# EasyEDA Pro project PR.eprj, schematic 新大符2.0
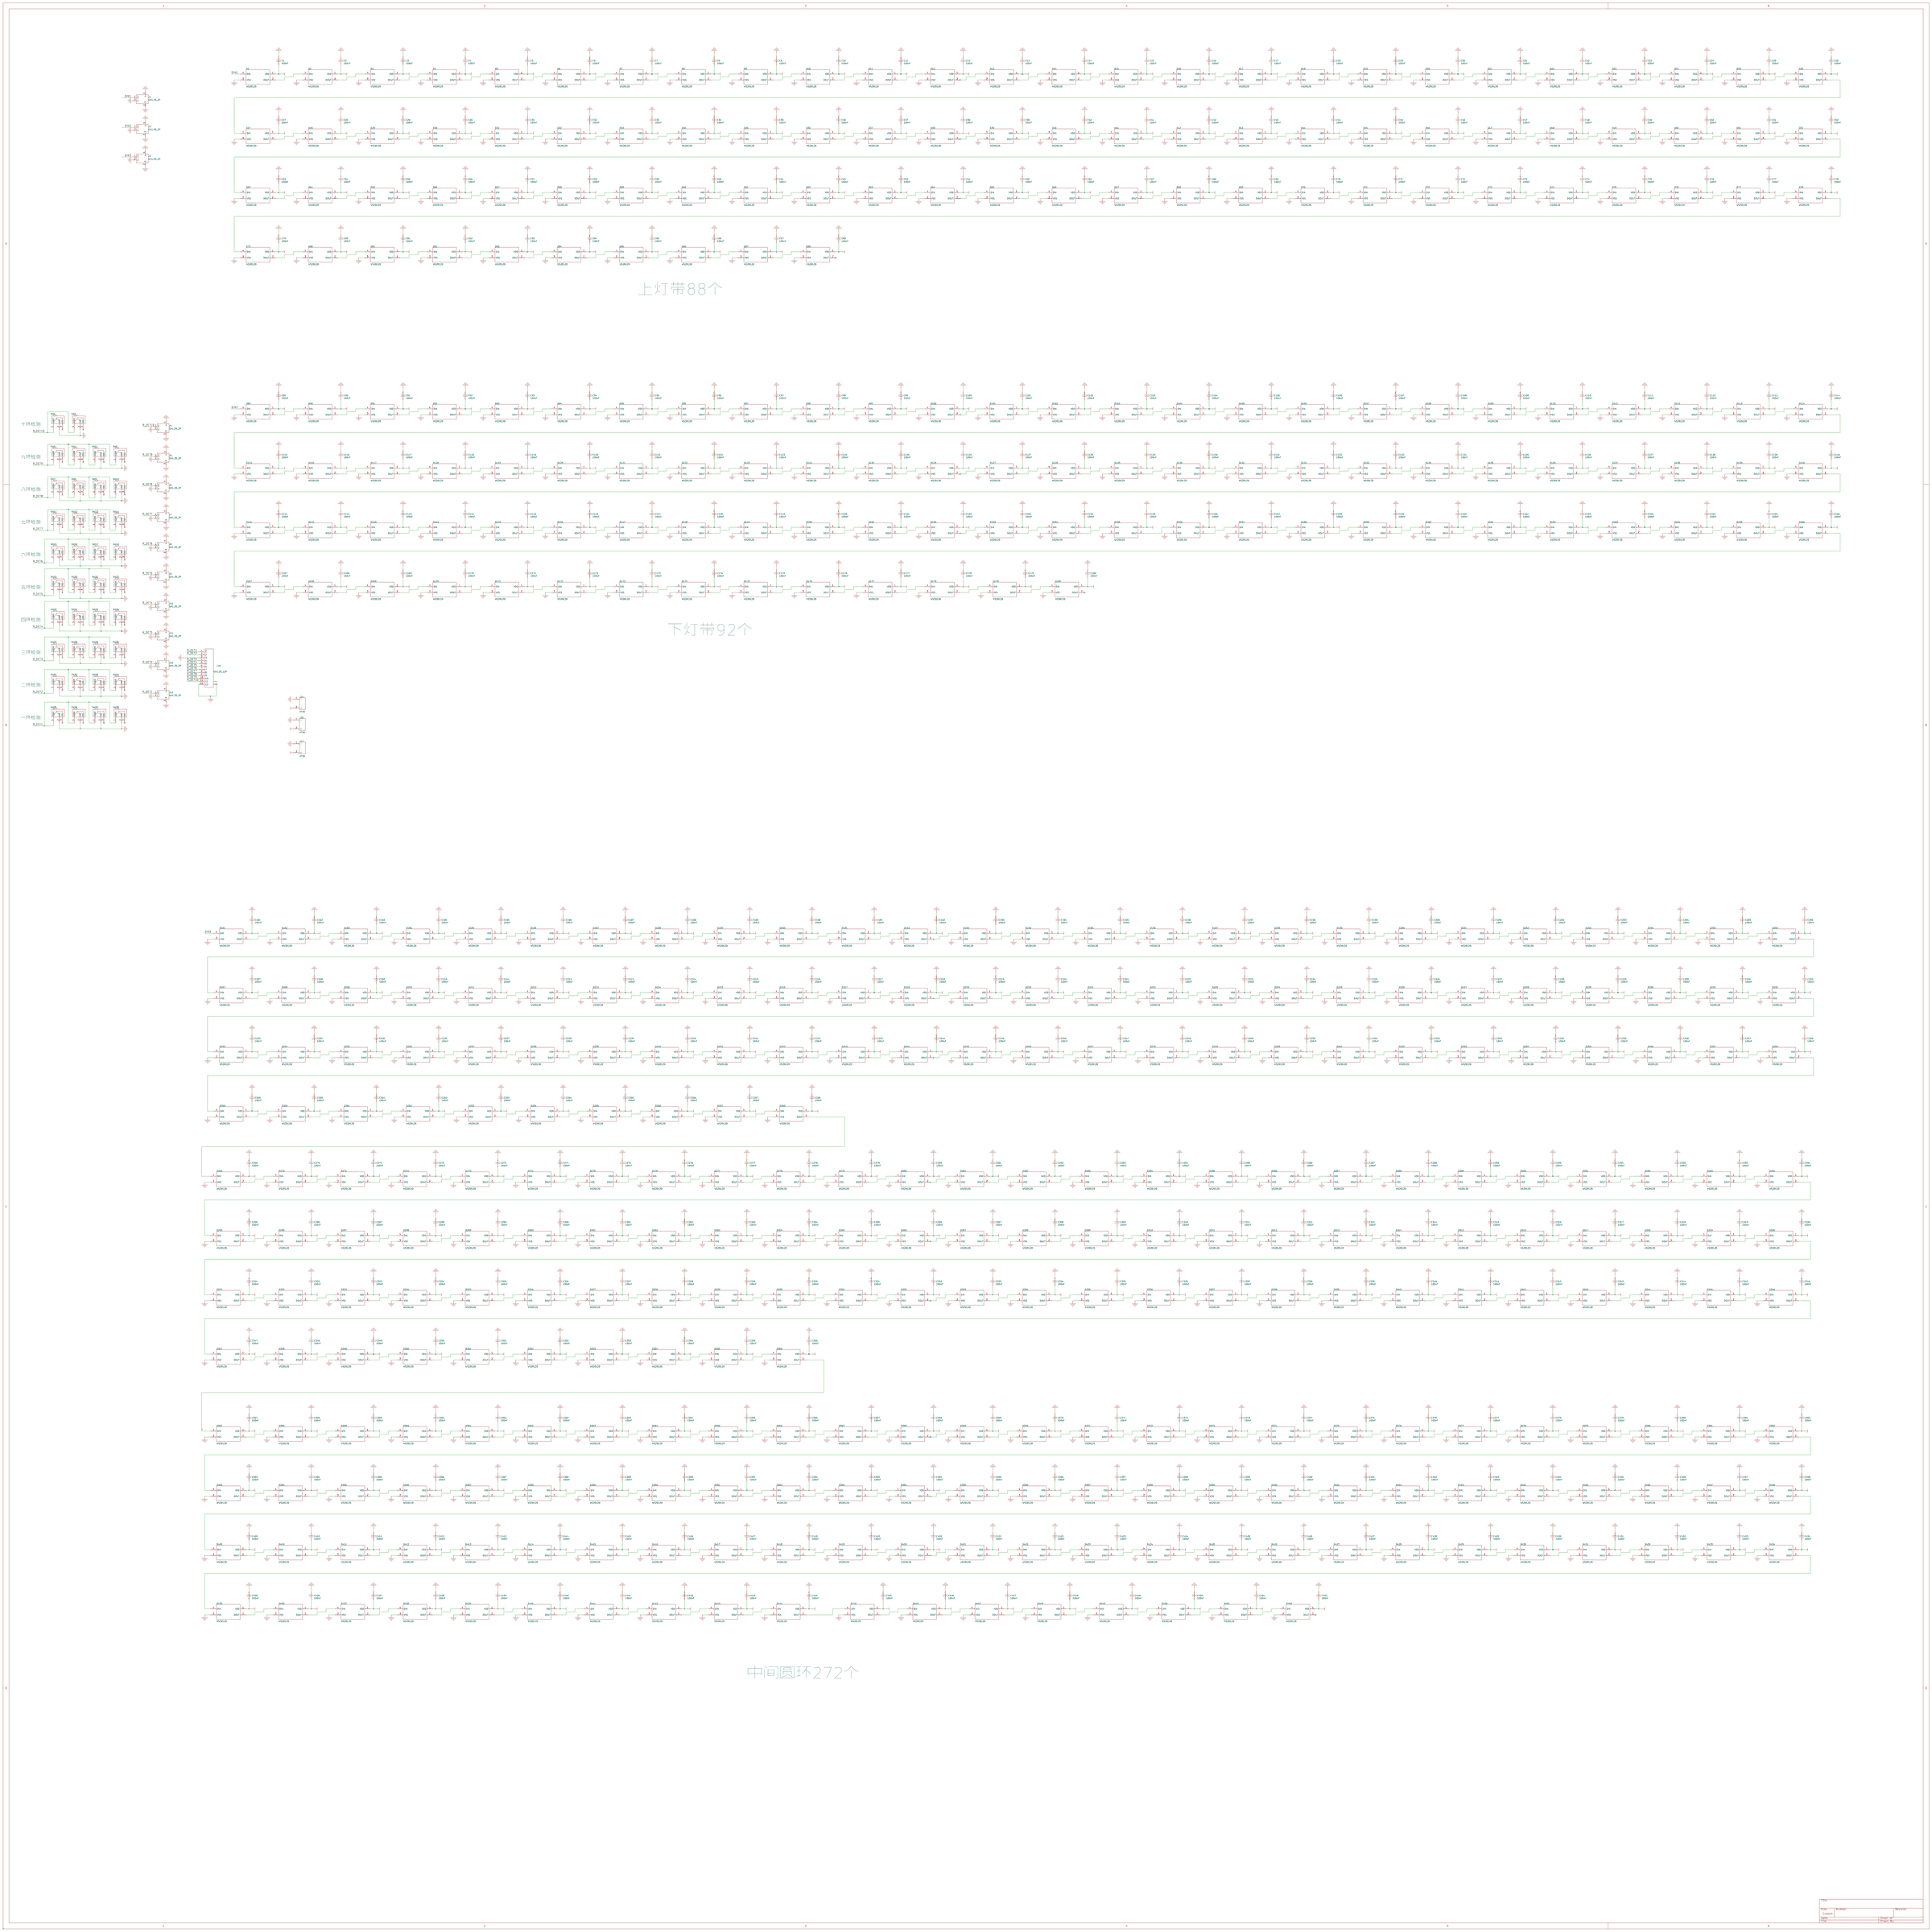
[diagram p0: schematic sheet]

## Parts
C1  100nF  [C_0603]
C2  100nF  [C_0603]
C3  100nF  [C_0603]
C4  100nF  [C_0603]
C5  100nF  [C_0603]
C6  100nF  [C_0603]
C7  100nF  [C_0603]
C8  100nF  [C_0603]
C9  100nF  [C_0603]
C10  100nF  [C_0603]
C11  100nF  [C_0603]
C12  100nF  [C_0603]
C13  100nF  [C_0603]
C14  100nF  [C_0603]
C15  100nF  [C_0603]
C16  100nF  [C_0603]
C17  100nF  [C_0603]
C18  100nF  [C_0603]
C19  100nF  [C_0603]
C20  100nF  [C_0603]
C21  100nF  [C_0603]
C22  100nF  [C_0603]
C23  100nF  [C_0603]
C24  100nF  [C_0603]
C25  100nF  [C_0603]
C26  100nF  [C_0603]
C27  100nF  [C_0603]
C28  100nF  [C_0603]
C29  100nF  [C_0603]
C30  100nF  [C_0603]
C31  100nF  [C_0603]
C32  100nF  [C_0603]
C33  100nF  [C_0603]
C34  100nF  [C_0603]
C35  100nF  [C_0603]
C36  100nF  [C_0603]
C37  100nF  [C_0603]
C38  100nF  [C_0603]
C39  100nF  [C_0603]
C40  100nF  [C_0603]
C41  100nF  [C_0603]
C42  100nF  [C_0603]
C43  100nF  [C_0603]
C44  100nF  [C_0603]
C45  100nF  [C_0603]
C46  100nF  [C_0603]
C47  100nF  [C_0603]
C48  100nF  [C_0603]
C49  100nF  [C_0603]
C50  100nF  [C_0603]
C51  100nF  [C_0603]
C52  100nF  [C_0603]
C53  100nF  [C_0603]
C54  100nF  [C_0603]
C55  100nF  [C_0603]
C56  100nF  [C_0603]
C57  100nF  [C_0603]
C58  100nF  [C_0603]
C59  100nF  [C_0603]
C60  100nF  [C_0603]
C61  100nF  [C_0603]
C62  100nF  [C_0603]
C63  100nF  [C_0603]
C64  100nF  [C_0603]
C65  100nF  [C_0603]
C66  100nF  [C_0603]
C67  100nF  [C_0603]
C68  100nF  [C_0603]
C69  100nF  [C_0603]
C70  100nF  [C_0603]
C71  100nF  [C_0603]
C72  100nF  [C_0603]
C73  100nF  [C_0603]
C74  100nF  [C_0603]
C75  100nF  [C_0603]
C76  100nF  [C_0603]
C77  100nF  [C_0603]
C78  100nF  [C_0603]
C79  100nF  [C_0603]
C80  100nF  [C_0603]
C81  100nF  [C_0603]
C82  100nF  [C_0603]
C83  100nF  [C_0603]
C84  100nF  [C_0603]
C85  100nF  [C_0603]
C86  100nF  [C_0603]
C87  100nF  [C_0603]
C88  100nF  [C_0603]
C89  100nF  [C_0603]
C90  100nF  [C_0603]
C91  100nF  [C_0603]
C92  100nF  [C_0603]
C93  100nF  [C_0603]
C94  100nF  [C_0603]
C95  100nF  [C_0603]
C96  100nF  [C_0603]
C97  100nF  [C_0603]
C98  100nF  [C_0603]
C99  100nF  [C_0603]
C100  100nF  [C_0603]
C101  100nF  [C_0603]
C102  100nF  [C_0603]
C103  100nF  [C_0603]
C104  100nF  [C_0603]
C105  100nF  [C_0603]
C106  100nF  [C_0603]
C107  100nF  [C_0603]
C108  100nF  [C_0603]
C109  100nF  [C_0603]
C110  100nF  [C_0603]
C111  100nF  [C_0603]
C112  100nF  [C_0603]
C113  100nF  [C_0603]
C114  100nF  [C_0603]
C115  100nF  [C_0603]
C116  100nF  [C_0603]
C117  100nF  [C_0603]
C118  100nF  [C_0603]
C119  100nF  [C_0603]
C120  100nF  [C_0603]
C121  100nF  [C_0603]
C122  100nF  [C_0603]
C123  100nF  [C_0603]
C124  100nF  [C_0603]
C125  100nF  [C_0603]
C126  100nF  [C_0603]
C127  100nF  [C_0603]
C128  100nF  [C_0603]
C129  100nF  [C_0603]
C130  100nF  [C_0603]
C131  100nF  [C_0603]
C132  100nF  [C_0603]
C133  100nF  [C_0603]
C134  100nF  [C_0603]
C135  100nF  [C_0603]
C136  100nF  [C_0603]
C137  100nF  [C_0603]
C138  100nF  [C_0603]
C139  100nF  [C_0603]
C140  100nF  [C_0603]
C141  100nF  [C_0603]
C142  100nF  [C_0603]
C143  100nF  [C_0603]
C144  100nF  [C_0603]
C145  100nF  [C_0603]
C146  100nF  [C_0603]
C147  100nF  [C_0603]
C148  100nF  [C_0603]
C149  100nF  [C_0603]
C150  100nF  [C_0603]
C151  100nF  [C_0603]
C152  100nF  [C_0603]
C153  100nF  [C_0603]
C154  100nF  [C_0603]
C155  100nF  [C_0603]
C156  100nF  [C_0603]
C157  100nF  [C_0603]
C158  100nF  [C_0603]
C159  100nF  [C_0603]
C160  100nF  [C_0603]
C161  100nF  [C_0603]
C162  100nF  [C_0603]
C163  100nF  [C_0603]
C164  100nF  [C_0603]
C165  100nF  [C_0603]
C166  100nF  [C_0603]
C167  100nF  [C_0603]
C168  100nF  [C_0603]
C169  100nF  [C_0603]
C170  100nF  [C_0603]
C171  100nF  [C_0603]
C172  100nF  [C_0603]
C173  100nF  [C_0603]
C174  100nF  [C_0603]
C175  100nF  [C_0603]
C176  100nF  [C_0603]
C177  100nF  [C_0603]
C178  100nF  [C_0603]
C179  100nF  [C_0603]
C180  100nF  [C_0603]
C181  100nF  [C_0603]
C182  100nF  [C_0603]
C183  100nF  [C_0603]
C184  100nF  [C_0603]
C185  100nF  [C_0603]
C186  100nF  [C_0603]
C187  100nF  [C_0603]
C188  100nF  [C_0603]
C189  100nF  [C_0603]
C190  100nF  [C_0603]
C191  100nF  [C_0603]
C192  100nF  [C_0603]
C193  100nF  [C_0603]
C194  100nF  [C_0603]
C195  100nF  [C_0603]
C196  100nF  [C_0603]
C197  100nF  [C_0603]
C198  100nF  [C_0603]
C199  100nF  [C_0603]
C200  100nF  [C_0603]
C201  100nF  [C_0603]
C202  100nF  [C_0603]
C203  100nF  [C_0603]
C204  100nF  [C_0603]
C205  100nF  [C_0603]
C206  100nF  [C_0603]
C207  100nF  [C_0603]
C208  100nF  [C_0603]
C209  100nF  [C_0603]
C210  100nF  [C_0603]
C211  100nF  [C_0603]
C212  100nF  [C_0603]
C213  100nF  [C_0603]
C214  100nF  [C_0603]
C215  100nF  [C_0603]
C216  100nF  [C_0603]
C217  100nF  [C_0603]
C218  100nF  [C_0603]
C219  100nF  [C_0603]
C220  100nF  [C_0603]
C221  100nF  [C_0603]
C222  100nF  [C_0603]
C223  100nF  [C_0603]
C224  100nF  [C_0603]
C225  100nF  [C_0603]
C226  100nF  [C_0603]
C227  100nF  [C_0603]
C228  100nF  [C_0603]
C229  100nF  [C_0603]
C230  100nF  [C_0603]
C231  100nF  [C_0603]
C232  100nF  [C_0603]
C233  100nF  [C_0603]
C234  100nF  [C_0603]
C235  100nF  [C_0603]
C236  100nF  [C_0603]
C237  100nF  [C_0603]
C238  100nF  [C_0603]
C239  100nF  [C_0603]
C240  100nF  [C_0603]
C241  100nF  [C_0603]
C242  100nF  [C_0603]
C243  100nF  [C_0603]
C244  100nF  [C_0603]
C245  100nF  [C_0603]
C246  100nF  [C_0603]
C247  100nF  [C_0603]
C248  100nF  [C_0603]
C249  100nF  [C_0603]
C250  100nF  [C_0603]
C251  100nF  [C_0603]
C252  100nF  [C_0603]
C253  100nF  [C_0603]
C254  100nF  [C_0603]
C255  100nF  [C_0603]
C256  100nF  [C_0603]
C257  100nF  [C_0603]
C258  100nF  [C_0603]
C259  100nF  [C_0603]
C260  100nF  [C_0603]
C261  100nF  [C_0603]
C262  100nF  [C_0603]
C263  100nF  [C_0603]
C264  100nF  [C_0603]
C265  100nF  [C_0603]
C266  100nF  [C_0603]
C267  100nF  [C_0603]
C268  100nF  [C_0603]
C269  100nF  [C_0603]
C270  100nF  [C_0603]
C271  100nF  [C_0603]
C272  100nF  [C_0603]
C273  100nF  [C_0603]
C274  100nF  [C_0603]
C275  100nF  [C_0603]
C276  100nF  [C_0603]
C277  100nF  [C_0603]
C278  100nF  [C_0603]
C279  100nF  [C_0603]
C280  100nF  [C_0603]
C281  100nF  [C_0603]
C282  100nF  [C_0603]
C283  100nF  [C_0603]
C284  100nF  [C_0603]
C285  100nF  [C_0603]
C286  100nF  [C_0603]
C287  100nF  [C_0603]
C288  100nF  [C_0603]
C289  100nF  [C_0603]
C290  100nF  [C_0603]
C291  100nF  [C_0603]
C292  100nF  [C_0603]
C293  100nF  [C_0603]
C294  100nF  [C_0603]
C295  100nF  [C_0603]
C296  100nF  [C_0603]
C297  100nF  [C_0603]
C298  100nF  [C_0603]
C299  100nF  [C_0603]
C300  100nF  [C_0603]
C301  100nF  [C_0603]
C302  100nF  [C_0603]
C303  100nF  [C_0603]
C304  100nF  [C_0603]
C305  100nF  [C_0603]
C306  100nF  [C_0603]
C307  100nF  [C_0603]
C308  100nF  [C_0603]
C309  100nF  [C_0603]
C310  100nF  [C_0603]
C311  100nF  [C_0603]
C312  100nF  [C_0603]
C313  100nF  [C_0603]
C314  100nF  [C_0603]
C315  100nF  [C_0603]
C316  100nF  [C_0603]
C317  100nF  [C_0603]
C318  100nF  [C_0603]
C319  100nF  [C_0603]
C320  100nF  [C_0603]
C321  100nF  [C_0603]
C322  100nF  [C_0603]
C323  100nF  [C_0603]
C324  100nF  [C_0603]
C325  100nF  [C_0603]
C326  100nF  [C_0603]
C327  100nF  [C_0603]
C328  100nF  [C_0603]
C329  100nF  [C_0603]
C330  100nF  [C_0603]
C331  100nF  [C_0603]
C332  100nF  [C_0603]
C333  100nF  [C_0603]
C334  100nF  [C_0603]
C335  100nF  [C_0603]
C336  100nF  [C_0603]
C337  100nF  [C_0603]
C338  100nF  [C_0603]
C339  100nF  [C_0603]
C340  100nF  [C_0603]
C341  100nF  [C_0603]
C342  100nF  [C_0603]
C343  100nF  [C_0603]
C344  100nF  [C_0603]
C345  100nF  [C_0603]
C346  100nF  [C_0603]
C347  100nF  [C_0603]
C348  100nF  [C_0603]
C349  100nF  [C_0603]
C350  100nF  [C_0603]
C351  100nF  [C_0603]
C352  100nF  [C_0603]
C353  100nF  [C_0603]
C354  100nF  [C_0603]
C355  100nF  [C_0603]
C356  100nF  [C_0603]
C357  100nF  [C_0603]
C358  100nF  [C_0603]
C359  100nF  [C_0603]
C360  100nF  [C_0603]
C361  100nF  [C_0603]
C362  100nF  [C_0603]
C363  100nF  [C_0603]
C364  100nF  [C_0603]
C365  100nF  [C_0603]
C366  100nF  [C_0603]
C367  100nF  [C_0603]
C368  100nF  [C_0603]
C369  100nF  [C_0603]
C370  100nF  [C_0603]
C371  100nF  [C_0603]
C372  100nF  [C_0603]
C373  100nF  [C_0603]
C374  100nF  [C_0603]
C375  100nF  [C_0603]
C376  100nF  [C_0603]
C377  100nF  [C_0603]
C378  100nF  [C_0603]
C379  100nF  [C_0603]
C380  100nF  [C_0603]
C381  100nF  [C_0603]
C382  100nF  [C_0603]
C383  100nF  [C_0603]
C384  100nF  [C_0603]
C385  100nF  [C_0603]
C386  100nF  [C_0603]
C387  100nF  [C_0603]
C388  100nF  [C_0603]
C389  100nF  [C_0603]
C390  100nF  [C_0603]
C391  100nF  [C_0603]
C392  100nF  [C_0603]
C393  100nF  [C_0603]
C394  100nF  [C_0603]
C395  100nF  [C_0603]
C396  100nF  [C_0603]
C397  100nF  [C_0603]
C398  100nF  [C_0603]
C399  100nF  [C_0603]
C400  100nF  [C_0603]
C401  100nF  [C_0603]
C402  100nF  [C_0603]
C403  100nF  [C_0603]
C404  100nF  [C_0603]
C405  100nF  [C_0603]
C406  100nF  [C_0603]
C407  100nF  [C_0603]
C408  100nF  [C_0603]
C409  100nF  [C_0603]
C410  100nF  [C_0603]
C411  100nF  [C_0603]
C412  100nF  [C_0603]
C413  100nF  [C_0603]
C414  100nF  [C_0603]
C415  100nF  [C_0603]
C416  100nF  [C_0603]
C417  100nF  [C_0603]
C418  100nF  [C_0603]
C419  100nF  [C_0603]
C420  100nF  [C_0603]
C421  100nF  [C_0603]
C422  100nF  [C_0603]
C423  100nF  [C_0603]
C424  100nF  [C_0603]
C425  100nF  [C_0603]
C426  100nF  [C_0603]
C427  100nF  [C_0603]
C428  100nF  [C_0603]
C429  100nF  [C_0603]
C430  100nF  [C_0603]
C431  100nF  [C_0603]
C432  100nF  [C_0603]
C433  100nF  [C_0603]
C434  100nF  [C_0603]
C435  100nF  [C_0603]
C436  100nF  [C_0603]
C437  100nF  [C_0603]
C438  100nF  [C_0603]
C439  100nF  [C_0603]
C440  100nF  [C_0603]
C441  100nF  [C_0603]
C442  100nF  [C_0603]
C443  100nF  [C_0603]
C444  100nF  [C_0603]
C445  100nF  [C_0603]
C446  100nF  [C_0603]
C447  100nF  [C_0603]
C448  100nF  [C_0603]
C449  100nF  [C_0603]
C450  100nF  [C_0603]
C451  100nF  [C_0603]
C452  100nF  [C_0603]
D1  *  [LED-SMD_4P-L5.0-W5.0-TL_WS2812B-B]
D2  *  [LED-SMD_4P-L5.0-W5.0-TL_WS2812B-B]
D3  *  [LED-SMD_4P-L5.0-W5.0-TL_WS2812B-B]
D4  *  [LED-SMD_4P-L5.0-W5.0-TL_WS2812B-B]
D5  *  [LED-SMD_4P-L5.0-W5.0-TL_WS2812B-B]
D6  *  [LED-SMD_4P-L5.0-W5.0-TL_WS2812B-B]
D7  *  [LED-SMD_4P-L5.0-W5.0-TL_WS2812B-B]
D8  *  [LED-SMD_4P-L5.0-W5.0-TL_WS2812B-B]
D9  *  [LED-SMD_4P-L5.0-W5.0-TL_WS2812B-B]
D10  *  [LED-SMD_4P-L5.0-W5.0-TL_WS2812B-B]
D11  *  [LED-SMD_4P-L5.0-W5.0-TL_WS2812B-B]
D12  *  [LED-SMD_4P-L5.0-W5.0-TL_WS2812B-B]
D13  *  [LED-SMD_4P-L5.0-W5.0-TL_WS2812B-B]
D14  *  [LED-SMD_4P-L5.0-W5.0-TL_WS2812B-B]
D15  *  [LED-SMD_4P-L5.0-W5.0-TL_WS2812B-B]
D16  *  [LED-SMD_4P-L5.0-W5.0-TL_WS2812B-B]
D17  *  [LED-SMD_4P-L5.0-W5.0-TL_WS2812B-B]
D18  *  [LED-SMD_4P-L5.0-W5.0-TL_WS2812B-B]
D19  *  [LED-SMD_4P-L5.0-W5.0-TL_WS2812B-B]
D20  *  [LED-SMD_4P-L5.0-W5.0-TL_WS2812B-B]
D21  *  [LED-SMD_4P-L5.0-W5.0-TL_WS2812B-B]
D22  *  [LED-SMD_4P-L5.0-W5.0-TL_WS2812B-B]
D23  *  [LED-SMD_4P-L5.0-W5.0-TL_WS2812B-B]
D24  *  [LED-SMD_4P-L5.0-W5.0-TL_WS2812B-B]
D25  *  [LED-SMD_4P-L5.0-W5.0-TL_WS2812B-B]
D26  *  [LED-SMD_4P-L5.0-W5.0-TL_WS2812B-B]
D27  *  [LED-SMD_4P-L5.0-W5.0-TL_WS2812B-B]
D28  *  [LED-SMD_4P-L5.0-W5.0-TL_WS2812B-B]
D29  *  [LED-SMD_4P-L5.0-W5.0-TL_WS2812B-B]
D30  *  [LED-SMD_4P-L5.0-W5.0-TL_WS2812B-B]
D31  *  [LED-SMD_4P-L5.0-W5.0-TL_WS2812B-B]
D32  *  [LED-SMD_4P-L5.0-W5.0-TL_WS2812B-B]
D33  *  [LED-SMD_4P-L5.0-W5.0-TL_WS2812B-B]
D34  *  [LED-SMD_4P-L5.0-W5.0-TL_WS2812B-B]
D35  *  [LED-SMD_4P-L5.0-W5.0-TL_WS2812B-B]
D36  *  [LED-SMD_4P-L5.0-W5.0-TL_WS2812B-B]
D37  *  [LED-SMD_4P-L5.0-W5.0-TL_WS2812B-B]
D38  *  [LED-SMD_4P-L5.0-W5.0-TL_WS2812B-B]
D39  *  [LED-SMD_4P-L5.0-W5.0-TL_WS2812B-B]
D40  *  [LED-SMD_4P-L5.0-W5.0-TL_WS2812B-B]
D41  *  [LED-SMD_4P-L5.0-W5.0-TL_WS2812B-B]
D42  *  [LED-SMD_4P-L5.0-W5.0-TL_WS2812B-B]
D43  *  [LED-SMD_4P-L5.0-W5.0-TL_WS2812B-B]
D44  *  [LED-SMD_4P-L5.0-W5.0-TL_WS2812B-B]
D45  *  [LED-SMD_4P-L5.0-W5.0-TL_WS2812B-B]
D46  *  [LED-SMD_4P-L5.0-W5.0-TL_WS2812B-B]
D47  *  [LED-SMD_4P-L5.0-W5.0-TL_WS2812B-B]
D48  *  [LED-SMD_4P-L5.0-W5.0-TL_WS2812B-B]
D49  *  [LED-SMD_4P-L5.0-W5.0-TL_WS2812B-B]
D50  *  [LED-SMD_4P-L5.0-W5.0-TL_WS2812B-B]
D51  *  [LED-SMD_4P-L5.0-W5.0-TL_WS2812B-B]
D52  *  [LED-SMD_4P-L5.0-W5.0-TL_WS2812B-B]
D53  *  [LED-SMD_4P-L5.0-W5.0-TL_WS2812B-B]
D54  *  [LED-SMD_4P-L5.0-W5.0-TL_WS2812B-B]
D55  *  [LED-SMD_4P-L5.0-W5.0-TL_WS2812B-B]
D56  *  [LED-SMD_4P-L5.0-W5.0-TL_WS2812B-B]
D57  *  [LED-SMD_4P-L5.0-W5.0-TL_WS2812B-B]
D58  *  [LED-SMD_4P-L5.0-W5.0-TL_WS2812B-B]
D59  *  [LED-SMD_4P-L5.0-W5.0-TL_WS2812B-B]
D60  *  [LED-SMD_4P-L5.0-W5.0-TL_WS2812B-B]
D61  *  [LED-SMD_4P-L5.0-W5.0-TL_WS2812B-B]
D62  *  [LED-SMD_4P-L5.0-W5.0-TL_WS2812B-B]
D63  *  [LED-SMD_4P-L5.0-W5.0-TL_WS2812B-B]
D64  *  [LED-SMD_4P-L5.0-W5.0-TL_WS2812B-B]
D65  *  [LED-SMD_4P-L5.0-W5.0-TL_WS2812B-B]
D66  *  [LED-SMD_4P-L5.0-W5.0-TL_WS2812B-B]
D67  *  [LED-SMD_4P-L5.0-W5.0-TL_WS2812B-B]
D68  *  [LED-SMD_4P-L5.0-W5.0-TL_WS2812B-B]
D69  *  [LED-SMD_4P-L5.0-W5.0-TL_WS2812B-B]
D70  *  [LED-SMD_4P-L5.0-W5.0-TL_WS2812B-B]
D71  *  [LED-SMD_4P-L5.0-W5.0-TL_WS2812B-B]
D72  *  [LED-SMD_4P-L5.0-W5.0-TL_WS2812B-B]
D73  *  [LED-SMD_4P-L5.0-W5.0-TL_WS2812B-B]
D74  *  [LED-SMD_4P-L5.0-W5.0-TL_WS2812B-B]
D75  *  [LED-SMD_4P-L5.0-W5.0-TL_WS2812B-B]
D76  *  [LED-SMD_4P-L5.0-W5.0-TL_WS2812B-B]
D77  *  [LED-SMD_4P-L5.0-W5.0-TL_WS2812B-B]
D78  *  [LED-SMD_4P-L5.0-W5.0-TL_WS2812B-B]
D79  *  [LED-SMD_4P-L5.0-W5.0-TL_WS2812B-B]
D80  *  [LED-SMD_4P-L5.0-W5.0-TL_WS2812B-B]
D81  *  [LED-SMD_4P-L5.0-W5.0-TL_WS2812B-B]
D82  *  [LED-SMD_4P-L5.0-W5.0-TL_WS2812B-B]
D83  *  [LED-SMD_4P-L5.0-W5.0-TL_WS2812B-B]
D84  *  [LED-SMD_4P-L5.0-W5.0-TL_WS2812B-B]
D85  *  [LED-SMD_4P-L5.0-W5.0-TL_WS2812B-B]
D86  *  [LED-SMD_4P-L5.0-W5.0-TL_WS2812B-B]
D87  *  [LED-SMD_4P-L5.0-W5.0-TL_WS2812B-B]
D88  *  [LED-SMD_4P-L5.0-W5.0-TL_WS2812B-B]
D89  *  [LED-SMD_4P-L5.0-W5.0-TL_WS2812B-B]
D90  *  [LED-SMD_4P-L5.0-W5.0-TL_WS2812B-B]
D91  *  [LED-SMD_4P-L5.0-W5.0-TL_WS2812B-B]
D92  *  [LED-SMD_4P-L5.0-W5.0-TL_WS2812B-B]
D93  *  [LED-SMD_4P-L5.0-W5.0-TL_WS2812B-B]
D94  *  [LED-SMD_4P-L5.0-W5.0-TL_WS2812B-B]
D95  *  [LED-SMD_4P-L5.0-W5.0-TL_WS2812B-B]
D96  *  [LED-SMD_4P-L5.0-W5.0-TL_WS2812B-B]
D97  *  [LED-SMD_4P-L5.0-W5.0-TL_WS2812B-B]
D98  *  [LED-SMD_4P-L5.0-W5.0-TL_WS2812B-B]
D99  *  [LED-SMD_4P-L5.0-W5.0-TL_WS2812B-B]
D100  *  [LED-SMD_4P-L5.0-W5.0-TL_WS2812B-B]
D101  *  [LED-SMD_4P-L5.0-W5.0-TL_WS2812B-B]
D102  *  [LED-SMD_4P-L5.0-W5.0-TL_WS2812B-B]
D103  *  [LED-SMD_4P-L5.0-W5.0-TL_WS2812B-B]
D104  *  [LED-SMD_4P-L5.0-W5.0-TL_WS2812B-B]
D105  *  [LED-SMD_4P-L5.0-W5.0-TL_WS2812B-B]
D106  *  [LED-SMD_4P-L5.0-W5.0-TL_WS2812B-B]
D107  *  [LED-SMD_4P-L5.0-W5.0-TL_WS2812B-B]
D108  *  [LED-SMD_4P-L5.0-W5.0-TL_WS2812B-B]
D109  *  [LED-SMD_4P-L5.0-W5.0-TL_WS2812B-B]
D110  *  [LED-SMD_4P-L5.0-W5.0-TL_WS2812B-B]
D111  *  [LED-SMD_4P-L5.0-W5.0-TL_WS2812B-B]
D112  *  [LED-SMD_4P-L5.0-W5.0-TL_WS2812B-B]
D113  *  [LED-SMD_4P-L5.0-W5.0-TL_WS2812B-B]
D114  *  [LED-SMD_4P-L5.0-W5.0-TL_WS2812B-B]
D115  *  [LED-SMD_4P-L5.0-W5.0-TL_WS2812B-B]
D116  *  [LED-SMD_4P-L5.0-W5.0-TL_WS2812B-B]
D117  *  [LED-SMD_4P-L5.0-W5.0-TL_WS2812B-B]
D118  *  [LED-SMD_4P-L5.0-W5.0-TL_WS2812B-B]
D119  *  [LED-SMD_4P-L5.0-W5.0-TL_WS2812B-B]
D120  *  [LED-SMD_4P-L5.0-W5.0-TL_WS2812B-B]
D121  *  [LED-SMD_4P-L5.0-W5.0-TL_WS2812B-B]
D122  *  [LED-SMD_4P-L5.0-W5.0-TL_WS2812B-B]
D123  *  [LED-SMD_4P-L5.0-W5.0-TL_WS2812B-B]
D124  *  [LED-SMD_4P-L5.0-W5.0-TL_WS2812B-B]
D125  *  [LED-SMD_4P-L5.0-W5.0-TL_WS2812B-B]
D126  *  [LED-SMD_4P-L5.0-W5.0-TL_WS2812B-B]
D127  *  [LED-SMD_4P-L5.0-W5.0-TL_WS2812B-B]
D128  *  [LED-SMD_4P-L5.0-W5.0-TL_WS2812B-B]
D129  *  [LED-SMD_4P-L5.0-W5.0-TL_WS2812B-B]
D130  *  [LED-SMD_4P-L5.0-W5.0-TL_WS2812B-B]
D131  *  [LED-SMD_4P-L5.0-W5.0-TL_WS2812B-B]
D132  *  [LED-SMD_4P-L5.0-W5.0-TL_WS2812B-B]
D133  *  [LED-SMD_4P-L5.0-W5.0-TL_WS2812B-B]
D134  *  [LED-SMD_4P-L5.0-W5.0-TL_WS2812B-B]
D135  *  [LED-SMD_4P-L5.0-W5.0-TL_WS2812B-B]
D136  *  [LED-SMD_4P-L5.0-W5.0-TL_WS2812B-B]
D137  *  [LED-SMD_4P-L5.0-W5.0-TL_WS2812B-B]
D138  *  [LED-SMD_4P-L5.0-W5.0-TL_WS2812B-B]
D139  *  [LED-SMD_4P-L5.0-W5.0-TL_WS2812B-B]
D140  *  [LED-SMD_4P-L5.0-W5.0-TL_WS2812B-B]
D141  *  [LED-SMD_4P-L5.0-W5.0-TL_WS2812B-B]
D142  *  [LED-SMD_4P-L5.0-W5.0-TL_WS2812B-B]
D143  *  [LED-SMD_4P-L5.0-W5.0-TL_WS2812B-B]
D144  *  [LED-SMD_4P-L5.0-W5.0-TL_WS2812B-B]
D145  *  [LED-SMD_4P-L5.0-W5.0-TL_WS2812B-B]
D146  *  [LED-SMD_4P-L5.0-W5.0-TL_WS2812B-B]
D147  *  [LED-SMD_4P-L5.0-W5.0-TL_WS2812B-B]
D148  *  [LED-SMD_4P-L5.0-W5.0-TL_WS2812B-B]
D149  *  [LED-SMD_4P-L5.0-W5.0-TL_WS2812B-B]
D150  *  [LED-SMD_4P-L5.0-W5.0-TL_WS2812B-B]
D151  *  [LED-SMD_4P-L5.0-W5.0-TL_WS2812B-B]
D152  *  [LED-SMD_4P-L5.0-W5.0-TL_WS2812B-B]
D153  *  [LED-SMD_4P-L5.0-W5.0-TL_WS2812B-B]
D154  *  [LED-SMD_4P-L5.0-W5.0-TL_WS2812B-B]
D155  *  [LED-SMD_4P-L5.0-W5.0-TL_WS2812B-B]
D156  *  [LED-SMD_4P-L5.0-W5.0-TL_WS2812B-B]
D157  *  [LED-SMD_4P-L5.0-W5.0-TL_WS2812B-B]
D158  *  [LED-SMD_4P-L5.0-W5.0-TL_WS2812B-B]
D159  *  [LED-SMD_4P-L5.0-W5.0-TL_WS2812B-B]
D160  *  [LED-SMD_4P-L5.0-W5.0-TL_WS2812B-B]
D161  *  [LED-SMD_4P-L5.0-W5.0-TL_WS2812B-B]
D162  *  [LED-SMD_4P-L5.0-W5.0-TL_WS2812B-B]
D163  *  [LED-SMD_4P-L5.0-W5.0-TL_WS2812B-B]
D164  *  [LED-SMD_4P-L5.0-W5.0-TL_WS2812B-B]
D165  *  [LED-SMD_4P-L5.0-W5.0-TL_WS2812B-B]
D166  *  [LED-SMD_4P-L5.0-W5.0-TL_WS2812B-B]
D167  *  [LED-SMD_4P-L5.0-W5.0-TL_WS2812B-B]
D168  *  [LED-SMD_4P-L5.0-W5.0-TL_WS2812B-B]
D169  *  [LED-SMD_4P-L5.0-W5.0-TL_WS2812B-B]
D170  *  [LED-SMD_4P-L5.0-W5.0-TL_WS2812B-B]
D171  *  [LED-SMD_4P-L5.0-W5.0-TL_WS2812B-B]
D172  *  [LED-SMD_4P-L5.0-W5.0-TL_WS2812B-B]
D173  *  [LED-SMD_4P-L5.0-W5.0-TL_WS2812B-B]
D174  *  [LED-SMD_4P-L5.0-W5.0-TL_WS2812B-B]
D175  *  [LED-SMD_4P-L5.0-W5.0-TL_WS2812B-B]
D176  *  [LED-SMD_4P-L5.0-W5.0-TL_WS2812B-B]
D177  *  [LED-SMD_4P-L5.0-W5.0-TL_WS2812B-B]
D178  *  [LED-SMD_4P-L5.0-W5.0-TL_WS2812B-B]
D179  *  [LED-SMD_4P-L5.0-W5.0-TL_WS2812B-B]
D180  *  [LED-SMD_4P-L5.0-W5.0-TL_WS2812B-B]
D181  *  [LED-SMD_4P-L5.0-W5.0-TL_WS2812B-B]
D182  *  [LED-SMD_4P-L5.0-W5.0-TL_WS2812B-B]
D183  *  [LED-SMD_4P-L5.0-W5.0-TL_WS2812B-B]
D184  *  [LED-SMD_4P-L5.0-W5.0-TL_WS2812B-B]
D185  *  [LED-SMD_4P-L5.0-W5.0-TL_WS2812B-B]
D186  *  [LED-SMD_4P-L5.0-W5.0-TL_WS2812B-B]